# EasyEDA Pro project Archive.eprj, board ALU1.0
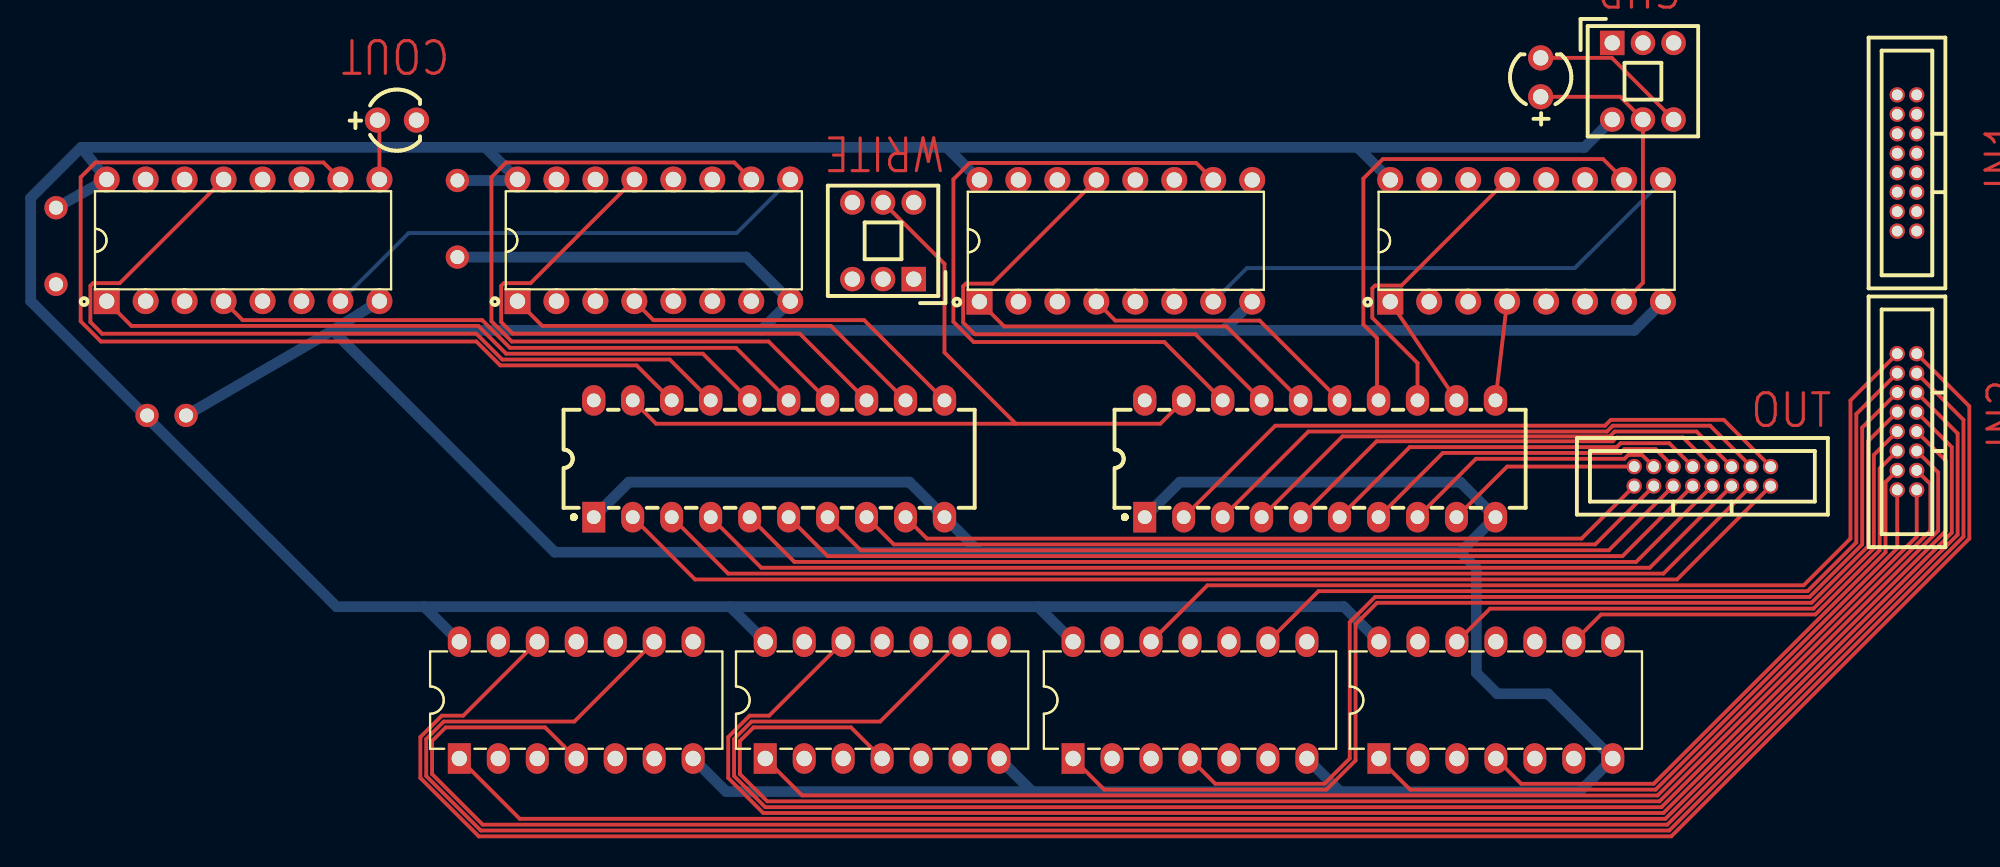
[diagram p16: board, top side]
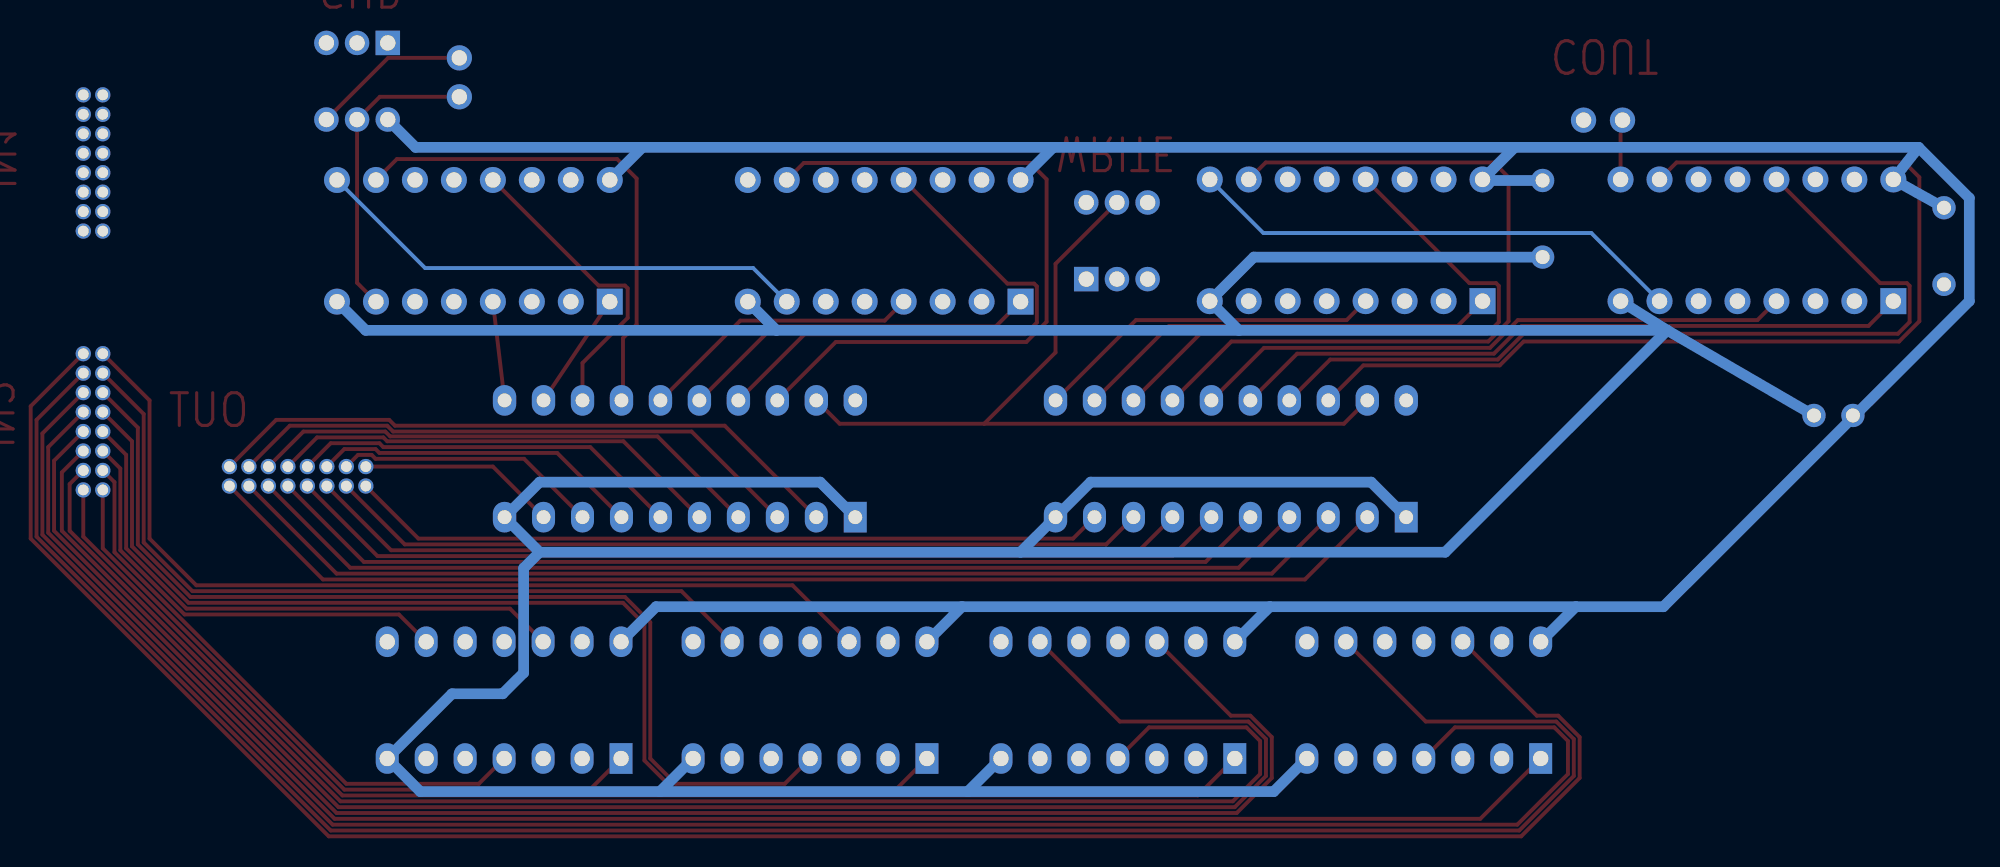
[diagram p17: board, bottom side, seen from below]

No outline. copper layers: Top Layer, Inner1, Inner2, Bottom Layer. Coordinates in mm from the lowest, leftmost part position.
Stack: Top Layer 0.035mm / Dielectric1 1.51mm FR4 er 4.5 / Inner1 0.035mm / Dielectric2 0.48mm PP er 4.5 / Inner2 0.035mm / Dielectric3 0.48mm PP er 4.5 / Bottom Layer 0.035mm

## Design rules (mm)
template: JLCPCB Capability(Two Layers Board)
spacing copperThickness1oz (default): track to track 0.102, other pairs 0.152 to 0.3
spacing copperThickness2oz: track to track 0.203, other pairs 0.152 to 0.3
track width copperThickness1oz (default): min 0.127, default 0.254, max 2.54
track width copperThickness2oz: min 0.203, default 0.254, max 2.54
differential pair differentialPair (default): width min 0.127, default 0.254, max 2.54; gap min 0.152, default 0.152
via viaSize (default): diameter min 0.5, default 0.61, max 10; hole min 0.3, default 0.305, max 6.3

## Placement (name value [footprint] x y rotation side)
CN1  -  [CONN-TH_IDC16-1.27]  120.65 18.16 90 top
CN1#2  -  [CONN-TH_IDC16-1.27]  107.31 14.6 0 top
CN1#3  -  [CONN-TH_IDC16-1.27]  120.65 35.05 90 top
NOREF  -  [Pad_e613]  0 32.13 0 top
NOREF#2  -  [Pad_e717]  26.16 28.91 0 top
NOREF#3  -  [Pad_e580]  5.94 18.58 0 top
NOREF#4  -  [Pad_e586]  8.48 18.58 0 top
NOREF#5  -  [Pad_e718]  26.16 33.91 0 top
NOREF#6  -  [Pad_e614]  0 27.13 0 top
SW2  -  [SW-TH_6P-L7.0-W7.0-P2.00]  103.44 40.39 90 top
SW2#2  -  [SW-TH_6P-L7.0-W7.0-P2.00]  53.91 29.97 270 top
U5  -  [DIP-20_L26.8-W6.4-P2.54-LS7.6-BL]  46.48 15.75 0 top
U5#2  -  [DIP-20_L26.8-W6.4-P2.54-LS7.6-BL]  82.4 15.75 0 top
U7  -  [DIP-16_L19.3-W6.4-P2.54-LS7.94-BL]  12.19 30.01 0 top
U7#2  -  [DIP-16_L19.3-W6.4-P2.54-LS7.94-BL]  69.08 29.97 0 top
U8  -  [DIP-16_L19.3-W6.4-P2.54-LS7.94-BL]  38.97 30.01 0 top
U8#2  -  [DIP-16_L19.3-W6.4-P2.54-LS7.94-BL]  95.86 29.97 0 top
U9  -  [DIP-14_L19.0-W6.4-P2.54-LS7.6-BL]  93.85 0 0 top
U9#2  -  [DIP-14_L19.0-W6.4-P2.54-LS7.6-BL]  73.91 0 0 top
U9#3  -  [DIP-14_L19.0-W6.4-P2.54-LS7.6-BL]  53.85 0 0 top
U9#4  -  [DIP-14_L19.0-W6.4-P2.54-LS7.6-BL]  33.91 0 0 top
U10  -  [LED-TH_BD4.0-P2.54-FD_RED]  96.77 40.64 90 top
U10#2  -  [LED-TH_BD4.0-P2.54-FD_RED]  22.22 37.85 0 top

## Footprints (pads in the part's own frame, mm; a bottom-side part is the same pattern mirrored in y, then rotated)
CONN-TH_IDC16-1.27
  round 1 hole 0.7: 1(-4.445,-0.635) 2(-4.445,0.635) 3(-3.175,-0.635) 4(-3.175,0.635) 5(-1.905,-0.635) 6(-1.905,0.635) 7(-0.635,-0.635) 8(-0.635,0.635) 9(0.635,-0.635) 10(0.635,0.635) 11(1.905,-0.635) 12(1.905,0.635) 13(3.175,-0.635) 14(3.175,0.635) 15(4.445,-0.635) 16(4.445,0.635)
DIP-14_L19.0-W6.4-P2.54-LS7.6-BL
  rect 1.5x2 hole 1: 1(-7.62,-3.81)
  oval 1.5x2 hole 1: 2(-5.08,-3.81) 3(-2.54,-3.81) 4(0,-3.81) 5(2.54,-3.81) 6(5.08,-3.81) 7(7.62,-3.81) 8(7.62,3.81) 9(5.08,3.81) 10(2.54,3.81) 11(0,3.81) 12(-2.54,3.81) 13(-5.08,3.81) 14(-7.62,3.81)
DIP-16_L19.3-W6.4-P2.54-LS7.94-BL
  rect 1.7x1.7 hole 1: 1(-8.89,-3.97)
  round 1.7 hole 1: 2(-6.35,-3.97) 3(-3.81,-3.97) 4(-1.27,-3.97) 5(1.27,-3.97) 6(3.81,-3.97) 7(6.35,-3.97) 8(8.89,-3.97) 9(8.89,3.97) 10(6.35,3.97) 11(3.81,3.97) 12(1.27,3.97) 13(-1.27,3.97) 14(-3.81,3.97) 15(-6.35,3.97) 16(-8.89,3.97)
DIP-20_L26.8-W6.4-P2.54-LS7.6-BL
  rect 1.5x2 hole 0.9: 1(-11.43,-3.81)
  oval 1.5x2 hole 0.9: 2(-8.89,-3.81) 3(-6.35,-3.81) 4(-3.81,-3.81) 5(-1.27,-3.81) 6(1.27,-3.81) 7(3.81,-3.81) 8(6.35,-3.81) 9(8.89,-3.81)
  oval 1.524x2 hole 0.9: 10(11.43,-3.81) 11(11.43,3.81) 12(8.89,3.81) 13(6.35,3.81) 14(3.81,3.81) 15(1.27,3.81) 16(-1.27,3.81) 17(-3.81,3.81) 18(-6.35,3.81) 19(-8.89,3.81) 20(-11.43,3.81)
LED-TH_BD4.0-P2.54-FD_RED
  round 1.651 hole 1: 1(-1.27,0) 2(1.27,0)
Pad_e580
  round 1.524 hole 0.914: 1(0,0)
Pad_e586
  round 1.524 hole 0.914: 2(0,0)
Pad_e613
  round 1.524 hole 0.914: 1(0,0)
Pad_e614
  round 1.524 hole 0.914: 2(0,0)
Pad_e717
  round 1.524 hole 0.914: 2(0,0)
Pad_e718
  round 1.524 hole 0.914: 1(0,0)
SW-TH_6P-L7.0-W7.0-P2.00
  rect 1.6x1.6 hole 1: 1(2.499,2)
  round 1.6 hole 1: 2(2.5,0) 3(2.5,-2) 4(-2.5,2) 5(-2.5,0) 6(-2.5,-2)

## Nets

Pads without a net: CN1 1 2 3 4 5 6 7 8 9 10 11 12 13 14 15 16; CN1#2 1 2 3 4 5 6 7 8 9 10 11 12 13 14 15 16; CN1#3 1 2 3 4 5 6 7 8 9 10 11 12 13 14 15 16; NOREF 1; NOREF#2 2; NOREF#3 1; NOREF#4 2; NOREF#5 1; NOREF#6 2; SW2 1 2 3 4 5 6; SW2#2 1 2 3 4 5 6; U5 1 2 3 4 5 6 7 8 9 10 11 12 13 14 15 16 17 18 19 20; U5#2 1 2 3 4 5 6 7 8 9 10 11 12 13 14 15 16 17 18 19 20; U7 1 2 3 4 5 6 7 8 9 10 11 12 13 14 15 16; U7#2 1 2 3 4 5 6 7 8 9 10 11 12 13 14 15 16; U8 1 2 3 4 5 6 7 8 9 10 11 12 13 14 15 16; U8#2 1 2 3 4 5 6 7 8 9 10 11 12 13 14 15 16; U9 1 2 3 4 5 6 7 8 9 10 11 12 13 14; U9#2 1 2 3 4 5 6 7 8 9 10 11 12 13 14; U9#3 1 2 3 4 5 6 7 8 9 10 11 12 13 14; U9#4 1 2 3 4 5 6 7 8 9 10 11 12 13 14; U10 1 2; U10#2 1 2

## Routing (per net, layer and track width the routed paths; a pad name or vN(x,y) marks a point on that pad's centre or on a via; arc(x,y) is an arc through that point)
(no net): length 5449.1
  Top Layer w0.254: U9#4.9 33.78,-1.4 25.27,-1.4 24.13,-2.54 24.13,-4.95 27.69,-8.51 105.16,-8.51 124.33,10.67 124.33,18.29 CN1.13 ; U5.13 48.48,23.91 29.78,23.91 29.02,24.67 29.02,27.03 29.2,27.21 30.93,27.21 U8.13 ; U5.11 52.67,24.8 38.94,24.8 U8.4 ; 45.21,11.94 48.13,9.02 103,9.02 CN1#2.9 ; U7#2.13 61.05,27.18 59.31,27.18 59.13,27 59.13,24.64 59.89,23.88 74.27,23.88 U5#2.17 ; U8.1 31.7,24.42 50.51,24.42 U5.12 ; CN1.7 123.19,15.62 123.19,11.05 104.77,-7.37 46.1,-7.37 43.81,-5.08 43.81,-2.41 45.21,-1.02 46.48,-1.02 51.31,3.81 ; 55.37,11.94 56.77,10.54 99.44,10.54 CN1#2.1 ; 42.67,11.94 45.97,8.64 103.89,8.64 CN1#2.11 ; U5#2.13 88.75,22 85.8,24.94 85.8,26.87 85.98,27.05 87.7,27.05 U8#2.13 ; CN1.12 117.73,17.78 117.73,10.16 114.3,6.73 85.98,6.73 84.33,5.08 84.33,-3.81 82.68,-5.46 75.56,-5.46 U9#2.4 ; U7#2.10 74.32,35.05 59.56,35.05 58.49,33.98 58.49,24.69 59.82,23.37 72.24,23.37 U5#2.18 ; CN1.11 123.95,17.4 123.95,10.8 105.03,-8.13 27.81,-8.13 24.51,-4.83 24.51,-2.67 25.4,-1.78 31.88,-1.78 U9#4.4 ; CN1.16 116.97,19.56 116.97,10.54 113.92,7.49 75.06,7.49 71.37,3.81 ; U9#3.1 48.64,-6.22 104.39,-6.22 121.29,10.67 CN1.1 ; CN1.6 118.87,15.11 118.87,9.78 114.68,5.59 100.71,5.59 U9.9 ; 62.56,18.03 71.98,18.03 U5#2.19 ; 62.56,18.03 39.12,18.03 U5.19 ; 62.56,18.03 57.91,22.69 57.91,28.47 SW2#2.5 ; 81.13,11.94 86.08,16.89 101.47,16.89 101.73,17.15 106.05,17.15 CN1#2.10 ; U9.12 93.47,5.97 114.55,5.97 118.49,9.91 118.49,16 CN1.8 ; U8#2.1 U5#2.12 ; U9#2.1 68.33,-5.84 82.8,-5.84 84.71,-3.94 84.71,4.95 86.11,6.35 114.43,6.35 118.11,10.03 118.11,16.89 CN1.10 ; SW2.6 101.42,41.91 U10.2 ; U8#2.4 U5#2.11 ; U9.1 88.26,-5.84 104.27,-5.84 120.01,9.91 CN1.2 ; 58.93,3.81 53.72,-1.4 45.34,-1.4 44.2,-2.54 44.2,-4.95 46.23,-6.98 104.65,-6.98 122.68,11.05 122.68,14.86 CN1.5 ; CN1#2.16 108.71,18.29 101.35,18.29 100.97,17.91 79.47,17.91 73.51,11.94 ; U8#2.7 103.44,27.23 SW2.5 101.95,39.37 U10.1 ; 78.59,11.94 83.86,17.21 101.28,17.21 101.6,17.53 106.93,17.53 CN1#2.12 ; 40.13,11.94 43.81,8.26 104.77,8.26 CN1#2.13 ; U7.4 12.16,24.8 27.78,24.8 29.59,22.99 44.32,22.99 U5.15 ; U7.9 21.08,36.96 ; U5#2.15 78.46,24.77 69.05,24.77 U7#2.4 ; U5.17 40,22.23 29.08,22.23 27.4,23.91 3,23.91 2.24,24.67 2.24,27.03 2.42,27.21 4.16,27.21 U7.13 ; CN1.15 124.71,19.18 124.71,10.54 105.28,-8.89 27.56,-8.89 23.75,-5.08 23.75,-2.41 25.15,-1.02 26.54,-1.02 U9#4.12 ; U7#2.1 61.81,24.38 76.3,24.38 U5#2.16 ; U5#2.14 86.11,19.66 86.11,23.62 85.22,24.51 85.22,34.04 86.49,35.31 100.84,35.31 U8#2.10 ; 37.59,11.94 41.66,7.87 105.66,7.87 CN1#2.15 ; 47.75,11.94 50.29,9.4 102.11,9.4 CN1#2.7 ; 50.29,11.94 52.45,9.78 101.22,9.78 CN1#2.5 ; U7.1 4.92,24.42 27.53,24.42 29.34,22.61 42.16,22.61 U5.16 ; 78.99,3.81 82.3,7.11 114.17,7.11 117.35,10.29 117.35,18.67 CN1.14 ; 86.21,11.94 90.4,16.13 101.98,16.13 102.24,16.38 104.27,16.38 CN1#2.6 ; U9#3.4 51.82,-1.78 45.47,-1.78 44.58,-2.67 44.58,-4.83 46.35,-6.6 104.52,-6.6 122.17,11.05 122.17,14.1 CN1.3 ; 88.75,11.94 92.56,15.75 102.24,15.75 102.49,16 103.38,16 CN1#2.4 ; CN1#2.8 105.16,16.76 101.98,16.76 101.73,16.51 88.24,16.51 83.67,11.94 ; CN1.4 119.25,14.22 119.25,9.65 104.14,-5.46 95.5,-5.46 U9.4 ; U5.14 46.45,23.4 29.7,23.4 28.38,24.72 28.38,34.12 29.35,35.09 44.21,35.09 U8.10 ; CN1#2.3 100.33,10.16 54.61,10.16 52.83,11.94 ; 76.05,11.94 81.63,17.53 101.09,17.53 101.47,17.91 107.82,17.91 CN1#2.14 ; U5.18 37.85,21.84 28.96,21.84 27.4,23.4 2.93,23.4 1.61,24.72 1.61,34.12 2.57,35.09 17.43,35.09 U7.10 ; 91.29,11.94 94.59,15.24 CN1#2.2 ; U9#4.1 30.23,-7.75 104.9,-7.75 123.57,10.92 123.57,16.51 CN1.9
  Inner1 w0.254: U7#2.11 76.58,30.25 76.58,23.9 74.8,22.12 74.8,11.05 73.91,10.16 U9#2.11 ; U8.11 42.86,33.98 50.29,26.54 50.29,22.1 51.56,20.83 51.56,9.4 53.85,7.11 U9#3.11 ; U9.11 95.5,5.46 95.5,19.43 93.73,21.21 88.65,21.21 84.96,24.89 84.96,34.16 86.36,35.56 98.05,35.56 U8#2.11 ; U8.6 46.48,22.33 46.48,8.13 47.5,7.11 47.5,0 51.31,-3.81 ; 99.31,-3.43 U9.6 98.93,-2.92 113.41,11.56 113.41,16.76 106.43,23.75 106.43,26.42 105.54,27.3 90.81,27.3 U8#2.2 ; U8#2.15 85.47,29.91 85.47,25.02 88.77,21.72 98.93,21.72 101.47,19.18 U9.8 ; U7.2 23.5,8.38 23.5,-3.81 25.65,-5.97 36.83,-5.97 U9#4.6 ; U7#2.15 64.73,35.94 77.98,35.94 80.07,33.85 80.07,5.27 U9#2.8 ; 78.99,-3.81 72.52,2.67 72.52,23.75 74.04,25.27 74.04,26.54 73.28,27.3 64.03,27.3 U7#2.2 ; U9#4.11 32.51,5.21 32.51,17.47 U7.11 ; U8.15 34.71,36.07 47.62,36.07 49.4,34.29 49.4,28.32 55.88,21.84 58.17,21.84 61.47,18.54 U9#3.8 ; U7#2.6 69.09,22.2 69.09,11.43 70.1,10.41 70.1,-2.54 71.37,-3.81 ; U8.2 34.14,27.56 48.01,27.56 49.15,26.42 49.15,10.41 52.45,7.11 52.45,2.67 58.93,-3.81 ; U7.6 30.23,11.81 30.23,-2.67 U9#4.3 ; U7.15 8.19,36.32 20.57,36.32 22.35,34.54 22.35,28.58 28.07,22.86 38.74,22.86 41.53,20.07 U9#4.8 ; U9.3 92.96,-2.16 98.81,-2.16 112.65,11.68 112.65,16.64 110.62,18.67 107,18.67 U8#2.6 ; 50.29,19.18 49.91,19.56
  Inner1 w0.7: NOREF#6.2 0.94,28.07 19.05,28.07 U7.8
  Inner2 w0.254: CN1#3.6 119.51,32.64 93.35,32.64 U8#2.14 ; U8#2.3 97.92,31.88 CN1#3.4 ; U8.12 38.53,35.69 32.26,35.69 31.37,34.8 31.37,25.65 33.4,23.62 116.46,23.62 122.81,29.97 122.81,32.89 CN1#3.7 ; U7.3 11.56,22.86 116.97,22.86 123.44,29.34 123.44,34.8 CN1#3.11 ; U7#2.5 71.65,27.3 78.49,27.3 86.87,35.69 CN1#3.10 ; CN1#3.9 123.13,33.85 123.13,29.65 116.71,23.24 16.26,23.24 U7.5 ; U7#2.3 66.95,27.69 78.11,27.69 87.38,36.96 CN1#3.12 ; U8#2.5 101.73,30.61 CN1#3.2 ; CN1#3.16 69.6,39.5 65.66,35.56 59.31,35.56 58.29,34.54 58.29,33.78 59.44,32.64 69.05,32.64 U7#2.12 ; CN1#3.14 69.56,38.23 U7#2.14 ; U8#2.12 98.36,35.18 119.25,35.18 CN1#3.8 ; U8.3 36.81,24.38 116.2,24.38 122.05,30.23 122.05,31.11 CN1#3.3 ; CN1#3.15 124.21,36.58 124.21,29.08 117.28,22.16 8.06,22.16 4.57,25.65 4.57,34.92 5.33,35.69 11.75,35.69 U7.12 ; U7#2.9 73.11,29.08 48.37,29.08 U8.7 ; CN1#3.5 122.43,32 122.43,30.1 116.33,24 35.43,24 33.78,25.65 33.78,32.6 U8.14 ; CN1#3.13 123.82,35.69 123.82,29.21 117.09,22.48 9.65,22.48 7.24,24.89 7.24,32.83 U7.14 ; CN1#3.1 115.44,24.77 41.51,24.77 U8.5
  Bottom Layer w0.254: U8.9 44.36,30.48 22.99,30.48 U7.7 ; U7#2.7 77.62,28.19 99,28.19 U8#2.9
  Bottom Layer w0.7: 84.84,36.07 99.62,36.07 SW2.4 ; 84.84,36.07 58.06,36.07 ; 84.84,36.07 U8#2.16 ; 91.54,9.65 92.58,8.61 92.58,1.78 93.95,0.41 97.25,0.41 U9.7 99.31,-5.97 83.69,-5.97 ; 91.54,9.65 93.83,11.94 91.54,14.22 73.25,14.22 70.97,11.94 ; 91.54,9.65 60.2,9.65 ; U8#2.8 102.88,24.13 76.1,24.13 ; 76.1,24.13 U7#2.8 ; 76.1,24.13 45.95,24.13 ; NOREF.1 U7.16 1.65,36.07 ; 58.06,36.07 27.99,36.07 ; 58.06,36.07 U7#2.16 ; 27.99,36.07 U8.16 30.01,33.91 NOREF#5.1 ; 27.99,36.07 1.65,36.07 ; 64.01,6.1 83.95,6.1 U9.14 ; 64.01,6.1 43.94,6.1 ; 64.01,6.1 U9#2.14 ; 83.69,-5.97 63.63,-5.97 ; 83.69,-5.97 U9#2.7 ; U7.8 18.03,24.13 ; 18.03,24.13 NOREF#4.2 ; 18.03,24.13 32.51,9.65 60.2,9.65 ; 18.03,24.13 45.95,24.13 ; 63.63,-5.97 43.69,-5.97 U9#4.7 ; 63.63,-5.97 U9#3.7 ; U9#3.14 43.94,6.1 ; 43.94,6.1 24,6.1 ; 24,6.1 18.29,6.1 -1.65,26.03 -1.65,32.77 1.65,36.07 ; 24,6.1 U9#4.14 ; 60.2,9.65 55.63,14.22 37.34,14.22 35.05,11.94 ; 45.95,24.13 U8.8 44.98,28.91 NOREF#2.2

## Text on the board
Top Layer: IN1 | COUT | SUB | OUT | IN2 | WRITE
